# EAGLE board Resistor_Resistor (EAGLE 8.3.0), part 29 of 32
## Placement (x,y rotation side) (continued)
R35434  10K  [0201]  241.15,21.39 0 top
R35435  10K  [0201]  241.15,22 0 top
R35436  10K  [0201]  241.15,22.61 0 top
R35437  10K  [0201]  241.15,23.22 0 top
R35438  10K  [0201]  241.15,23.83 0 top
R35439  10K  [0201]  241.15,24.43 0 top
R35440  10K  [0201]  241.15,25.04 0 top
R35441  10K  [0201]  241.15,25.65 0 top
R35442  10K  [0201]  241.15,26.26 0 top
R35443  10K  [0201]  241.15,26.87 0 top
R35444  10K  [0201]  241.15,27.48 0 top
R35445  10K  [0201]  241.15,28.09 0 top
R35446  10K  [0201]  241.15,28.7 0 top
R35447  10K  [0201]  241.15,29.31 0 top
R35448  10K  [0201]  241.15,29.92 0 top
R35449  10K  [0201]  241.15,30.53 0 top
R35450  10K  [0201]  241.15,31.14 0 top
R35451  10K  [0201]  241.15,31.75 0 top
R35452  10K  [0201]  241.15,32.36 0 top
R35453  10K  [0201]  241.15,32.97 0 top
R35454  10K  [0201]  241.15,33.58 0 top
R35455  10K  [0201]  241.15,34.19 0 top
R35456  10K  [0201]  241.15,34.8 0 top
R35457  10K  [0201]  241.15,35.41 0 top
R35458  10K  [0201]  241.15,36.02 0 top
R35459  10K  [0201]  241.15,36.63 0 top
R35460  10K  [0201]  241.15,37.24 0 top
R35461  10K  [0201]  241.15,37.85 0 top
R35462  10K  [0201]  241.15,38.46 0 top
R35463  10K  [0201]  241.15,39.07 0 top
R35464  10K  [0201]  241.15,39.67 0 top
R35465  10K  [0201]  241.15,40.28 0 top
R35466  10K  [0201]  241.15,40.89 0 top
R35467  10K  [0201]  241.15,41.5 0 top
R35468  10K  [0201]  241.15,42.11 0 top
R35469  10K  [0201]  241.15,42.72 0 top
R35470  10K  [0201]  241.15,43.33 0 top
R35471  10K  [0201]  241.15,43.94 0 top
R35472  10K  [0201]  241.15,44.55 0 top
R35473  10K  [0201]  241.15,45.16 0 top
R35474  10K  [0201]  241.15,45.77 0 top
R35475  10K  [0201]  241.15,46.38 0 top
R35476  10K  [0201]  241.15,46.99 0 top
R35477  10K  [0201]  241.15,47.6 0 top
R35478  10K  [0201]  241.15,48.21 0 top
R35479  10K  [0201]  241.15,48.82 0 top
R35480  10K  [0201]  241.15,49.43 0 top
R35481  10K  [0201]  241.15,50.04 0 top
R35482  10K  [0201]  241.15,50.65 0 top
R35483  10K  [0201]  241.15,51.26 0 top
R35484  10K  [0201]  241.15,51.87 0 top
R35485  10K  [0201]  241.15,52.48 0 top
R35486  10K  [0201]  241.15,53.09 0 top
R35487  10K  [0201]  241.15,53.7 0 top
R35488  10K  [0201]  241.15,54.31 0 top
R35489  10K  [0201]  241.15,54.91 0 top
R35490  10K  [0201]  241.15,55.52 0 top
R35491  10K  [0201]  241.15,56.13 0 top
R35492  10K  [0201]  241.15,56.74 0 top
R35493  10K  [0201]  241.15,57.35 0 top
R35494  10K  [0201]  241.15,57.96 0 top
R35495  10K  [0201]  241.15,58.57 0 top
R35496  10K  [0201]  241.15,59.18 0 top
R35497  10K  [0201]  241.15,59.79 0 top
R35498  10K  [0201]  241.15,60.4 0 top
R35499  10K  [0201]  241.15,61.01 0 top
R35500  10K  [0201]  241.15,61.62 0 top
R35501  10K  [0201]  241.15,62.23 0 top
R35502  10K  [0201]  241.15,62.84 0 top
R35503  10K  [0201]  241.15,63.45 0 top
R35504  10K  [0201]  241.15,64.06 0 top
R35505  10K  [0201]  241.15,64.67 0 top
R35506  10K  [0201]  241.15,65.28 0 top
R35507  10K  [0201]  241.15,65.89 0 top
R35508  10K  [0201]  241.15,66.5 0 top
R35509  10K  [0201]  241.15,67.11 0 top
R35510  10K  [0201]  241.15,67.72 0 top
R35511  10K  [0201]  241.15,68.33 0 top
R35512  10K  [0201]  241.15,68.94 0 top
R35513  10K  [0201]  241.15,69.55 0 top
R35514  10K  [0201]  241.15,70.15 0 top
R35515  10K  [0201]  241.15,70.76 0 top
R35516  10K  [0201]  241.15,71.37 0 top
R35517  10K  [0201]  241.15,71.98 0 top
R35518  10K  [0201]  241.15,72.59 0 top
R35519  10K  [0201]  241.15,73.2 0 top
R35520  10K  [0201]  241.15,73.81 0 top
R35521  10K  [0201]  241.15,74.42 0 top
R35522  10K  [0201]  241.15,75.03 0 top
R35523  10K  [0201]  241.15,75.64 0 top
R35524  10K  [0201]  241.15,76.25 0 top
R35525  10K  [0201]  241.15,76.86 0 top
R35526  10K  [0201]  241.15,77.47 0 top
R35527  10K  [0201]  241.15,78.08 0 top
R35528  10K  [0201]  241.15,78.69 0 top
R35529  10K  [0201]  241.15,79.3 0 top
R35530  10K  [0201]  241.15,79.91 0 top
R35531  10K  [0201]  241.15,80.52 0 top
R35532  10K  [0201]  241.15,81.13 0 top
R35533  10K  [0201]  241.15,81.74 0 top
R35534  10K  [0201]  241.15,82.35 0 top
R35535  10K  [0201]  241.15,82.96 0 top
R35536  10K  [0201]  241.15,83.57 0 top
R35537  10K  [0201]  241.15,84.18 0 top
R35538  10K  [0201]  241.15,84.79 0 top
R35539  10K  [0201]  241.15,85.39 0 top
R35540  10K  [0201]  241.15,86 0 top
R35541  10K  [0201]  241.15,86.61 0 top
R35542  10K  [0201]  241.15,87.22 0 top
R35543  10K  [0201]  241.15,87.83 0 top
R35544  10K  [0201]  241.15,88.44 0 top
R35545  10K  [0201]  241.15,89.05 0 top
R35546  10K  [0201]  241.15,89.66 0 top
R35547  10K  [0201]  241.15,90.27 0 top
R35548  10K  [0201]  241.15,90.88 0 top
R35549  10K  [0201]  241.15,91.49 0 top
R35550  10K  [0201]  241.15,92.1 0 top
R35551  10K  [0201]  241.15,92.71 0 top
R35552  10K  [0201]  241.15,93.32 0 top
R35553  10K  [0201]  241.15,93.93 0 top
R35554  10K  [0201]  241.15,94.54 0 top
R35555  10K  [0201]  241.15,95.15 0 top
R35556  10K  [0201]  241.15,95.76 0 top
R35557  10K  [0201]  241.15,96.37 0 top
R35558  10K  [0201]  241.15,96.98 0 top
R35559  10K  [0201]  241.15,97.59 0 top
R35560  10K  [0201]  241.15,98.2 0 top
R35561  10K  [0201]  241.15,98.81 0 top
R35562  10K  [0201]  241.15,99.42 0 top
R35563  10K  [0201]  241.15,100.03 0 top
R35564  10K  [0201]  241.15,100.63 0 top
R35565  10K  [0201]  241.15,101.24 0 top
R35566  10K  [0201]  241.15,101.85 0 top
R35567  10K  [0201]  241.15,102.46 0 top
R35568  10K  [0201]  241.15,103.07 0 top
R35569  10K  [0201]  241.15,103.68 0 top
R35570  10K  [0201]  241.15,104.29 0 top
R35571  10K  [0201]  241.15,104.9 0 top
R35572  10K  [0201]  241.15,105.51 0 top
R35573  10K  [0201]  241.15,106.12 0 top
R35574  10K  [0201]  241.15,106.73 0 top
R35575  10K  [0201]  241.15,107.34 0 top
R35576  10K  [0201]  241.15,107.95 0 top
R35577  10K  [0201]  241.15,108.56 0 top
R35578  10K  [0201]  241.15,109.17 0 top
R35579  10K  [0201]  241.15,109.78 0 top
R35580  10K  [0201]  241.15,110.39 0 top
R35581  10K  [0201]  241.15,111 0 top
R35582  10K  [0201]  241.15,111.61 0 top
R35583  10K  [0201]  241.15,112.22 0 top
R35584  10K  [0201]  241.15,112.83 0 top
R35585  10K  [0201]  241.15,113.44 0 top
R35586  10K  [0201]  241.15,114.05 0 top
R35587  10K  [0201]  241.15,114.66 0 top
R35588  10K  [0201]  241.15,115.27 0 top
R35589  10K  [0201]  241.15,115.87 0 top
R35590  10K  [0201]  241.15,116.48 0 top
R35591  10K  [0201]  241.15,117.09 0 top
R35592  10K  [0201]  241.15,117.7 0 top
R35593  10K  [0201]  241.15,118.31 0 top
R35594  10K  [0201]  241.15,118.92 0 top
R35595  10K  [0201]  241.15,119.53 0 top
R35596  10K  [0201]  241.15,120.14 0 top
R35597  10K  [0201]  241.15,120.75 0 top
R35598  10K  [0201]  241.15,121.36 0 top
R35599  10K  [0201]  241.15,121.97 0 top
R35600  10K  [0201]  241.15,122.58 0 top
R35601  10K  [0201]  242.37,1.27 0 top
R35602  10K  [0201]  242.37,1.88 0 top
R35603  10K  [0201]  242.37,2.49 0 top
R35604  10K  [0201]  242.37,3.1 0 top
R35605  10K  [0201]  242.37,3.71 0 top
R35606  10K  [0201]  242.37,4.32 0 top
R35607  10K  [0201]  242.37,4.93 0 top
R35608  10K  [0201]  242.37,5.54 0 top
R35609  10K  [0201]  242.37,6.15 0 top
R35610  10K  [0201]  242.37,6.76 0 top
R35611  10K  [0201]  242.37,7.37 0 top
R35612  10K  [0201]  242.37,7.98 0 top
R35613  10K  [0201]  242.37,8.59 0 top
R35614  10K  [0201]  242.37,9.19 0 top
R35615  10K  [0201]  242.37,9.8 0 top
R35616  10K  [0201]  242.37,10.41 0 top
R35617  10K  [0201]  242.37,11.02 0 top
R35618  10K  [0201]  242.37,11.63 0 top
R35619  10K  [0201]  242.37,12.24 0 top
R35620  10K  [0201]  242.37,12.85 0 top
R35621  10K  [0201]  242.37,13.46 0 top
R35622  10K  [0201]  242.37,14.07 0 top
R35623  10K  [0201]  242.37,14.68 0 top
R35624  10K  [0201]  242.37,15.29 0 top
R35625  10K  [0201]  242.37,15.9 0 top
R35626  10K  [0201]  242.37,16.51 0 top
R35627  10K  [0201]  242.37,17.12 0 top
R35628  10K  [0201]  242.37,17.73 0 top
R35629  10K  [0201]  242.37,18.34 0 top
R35630  10K  [0201]  242.37,18.95 0 top
R35631  10K  [0201]  242.37,19.56 0 top
R35632  10K  [0201]  242.37,20.17 0 top
R35633  10K  [0201]  242.37,20.78 0 top
R35634  10K  [0201]  242.37,21.39 0 top
R35635  10K  [0201]  242.37,22 0 top
R35636  10K  [0201]  242.37,22.61 0 top
R35637  10K  [0201]  242.37,23.22 0 top
R35638  10K  [0201]  242.37,23.83 0 top
R35639  10K  [0201]  242.37,24.43 0 top
R35640  10K  [0201]  242.37,25.04 0 top
R35641  10K  [0201]  242.37,25.65 0 top
R35642  10K  [0201]  242.37,26.26 0 top
R35643  10K  [0201]  242.37,26.87 0 top
R35644  10K  [0201]  242.37,27.48 0 top
R35645  10K  [0201]  242.37,28.09 0 top
R35646  10K  [0201]  242.37,28.7 0 top
R35647  10K  [0201]  242.37,29.31 0 top
R35648  10K  [0201]  242.37,29.92 0 top
R35649  10K  [0201]  242.37,30.53 0 top
R35650  10K  [0201]  242.37,31.14 0 top
R35651  10K  [0201]  242.37,31.75 0 top
R35652  10K  [0201]  242.37,32.36 0 top
R35653  10K  [0201]  242.37,32.97 0 top
R35654  10K  [0201]  242.37,33.58 0 top
R35655  10K  [0201]  242.37,34.19 0 top
R35656  10K  [0201]  242.37,34.8 0 top
R35657  10K  [0201]  242.37,35.41 0 top
R35658  10K  [0201]  242.37,36.02 0 top
R35659  10K  [0201]  242.37,36.63 0 top
R35660  10K  [0201]  242.37,37.24 0 top
R35661  10K  [0201]  242.37,37.85 0 top
R35662  10K  [0201]  242.37,38.46 0 top
R35663  10K  [0201]  242.37,39.07 0 top
R35664  10K  [0201]  242.37,39.67 0 top
R35665  10K  [0201]  242.37,40.28 0 top
R35666  10K  [0201]  242.37,40.89 0 top
R35667  10K  [0201]  242.37,41.5 0 top
R35668  10K  [0201]  242.37,42.11 0 top
R35669  10K  [0201]  242.37,42.72 0 top
R35670  10K  [0201]  242.37,43.33 0 top
R35671  10K  [0201]  242.37,43.94 0 top
R35672  10K  [0201]  242.37,44.55 0 top
R35673  10K  [0201]  242.37,45.16 0 top
R35674  10K  [0201]  242.37,45.77 0 top
R35675  10K  [0201]  242.37,46.38 0 top
R35676  10K  [0201]  242.37,46.99 0 top
R35677  10K  [0201]  242.37,47.6 0 top
R35678  10K  [0201]  242.37,48.21 0 top
R35679  10K  [0201]  242.37,48.82 0 top
R35680  10K  [0201]  242.37,49.43 0 top
R35681  10K  [0201]  242.37,50.04 0 top
R35682  10K  [0201]  242.37,50.65 0 top
R35683  10K  [0201]  242.37,51.26 0 top
R35684  10K  [0201]  242.37,51.87 0 top
R35685  10K  [0201]  242.37,52.48 0 top
R35686  10K  [0201]  242.37,53.09 0 top
R35687  10K  [0201]  242.37,53.7 0 top
R35688  10K  [0201]  242.37,54.31 0 top
R35689  10K  [0201]  242.37,54.91 0 top
R35690  10K  [0201]  242.37,55.52 0 top
R35691  10K  [0201]  242.37,56.13 0 top
R35692  10K  [0201]  242.37,56.74 0 top
R35693  10K  [0201]  242.37,57.35 0 top
R35694  10K  [0201]  242.37,57.96 0 top
R35695  10K  [0201]  242.37,58.57 0 top
R35696  10K  [0201]  242.37,59.18 0 top
R35697  10K  [0201]  242.37,59.79 0 top
R35698  10K  [0201]  242.37,60.4 0 top
R35699  10K  [0201]  242.37,61.01 0 top
R35700  10K  [0201]  242.37,61.62 0 top
R35701  10K  [0201]  242.37,62.23 0 top
R35702  10K  [0201]  242.37,62.84 0 top
R35703  10K  [0201]  242.37,63.45 0 top
R35704  10K  [0201]  242.37,64.06 0 top
R35705  10K  [0201]  242.37,64.67 0 top
R35706  10K  [0201]  242.37,65.28 0 top
R35707  10K  [0201]  242.37,65.89 0 top
R35708  10K  [0201]  242.37,66.5 0 top
R35709  10K  [0201]  242.37,67.11 0 top
R35710  10K  [0201]  242.37,67.72 0 top
R35711  10K  [0201]  242.37,68.33 0 top
R35712  10K  [0201]  242.37,68.94 0 top
R35713  10K  [0201]  242.37,69.55 0 top
R35714  10K  [0201]  242.37,70.15 0 top
R35715  10K  [0201]  242.37,70.76 0 top
R35716  10K  [0201]  242.37,71.37 0 top
R35717  10K  [0201]  242.37,71.98 0 top
R35718  10K  [0201]  242.37,72.59 0 top
R35719  10K  [0201]  242.37,73.2 0 top
R35720  10K  [0201]  242.37,73.81 0 top
R35721  10K  [0201]  242.37,74.42 0 top
R35722  10K  [0201]  242.37,75.03 0 top
R35723  10K  [0201]  242.37,75.64 0 top
R35724  10K  [0201]  242.37,76.25 0 top
R35725  10K  [0201]  242.37,76.86 0 top
R35726  10K  [0201]  242.37,77.47 0 top
R35727  10K  [0201]  242.37,78.08 0 top
R35728  10K  [0201]  242.37,78.69 0 top
R35729  10K  [0201]  242.37,79.3 0 top
R35730  10K  [0201]  242.37,79.91 0 top
R35731  10K  [0201]  242.37,80.52 0 top
R35732  10K  [0201]  242.37,81.13 0 top
R35733  10K  [0201]  242.37,81.74 0 top
R35734  10K  [0201]  242.37,82.35 0 top
R35735  10K  [0201]  242.37,82.96 0 top
R35736  10K  [0201]  242.37,83.57 0 top
R35737  10K  [0201]  242.37,84.18 0 top
R35738  10K  [0201]  242.37,84.79 0 top
R35739  10K  [0201]  242.37,85.39 0 top
R35740  10K  [0201]  242.37,86 0 top
R35741  10K  [0201]  242.37,86.61 0 top
R35742  10K  [0201]  242.37,87.22 0 top
R35743  10K  [0201]  242.37,87.83 0 top
R35744  10K  [0201]  242.37,88.44 0 top
R35745  10K  [0201]  242.37,89.05 0 top
R35746  10K  [0201]  242.37,89.66 0 top
R35747  10K  [0201]  242.37,90.27 0 top
R35748  10K  [0201]  242.37,90.88 0 top
R35749  10K  [0201]  242.37,91.49 0 top
R35750  10K  [0201]  242.37,92.1 0 top
R35751  10K  [0201]  242.37,92.71 0 top
R35752  10K  [0201]  242.37,93.32 0 top
R35753  10K  [0201]  242.37,93.93 0 top
R35754  10K  [0201]  242.37,94.54 0 top
R35755  10K  [0201]  242.37,95.15 0 top
R35756  10K  [0201]  242.37,95.76 0 top
R35757  10K  [0201]  242.37,96.37 0 top
R35758  10K  [0201]  242.37,96.98 0 top
R35759  10K  [0201]  242.37,97.59 0 top
R35760  10K  [0201]  242.37,98.2 0 top
R35761  10K  [0201]  242.37,98.81 0 top
R35762  10K  [0201]  242.37,99.42 0 top
R35763  10K  [0201]  242.37,100.03 0 top
R35764  10K  [0201]  242.37,100.63 0 top
R35765  10K  [0201]  242.37,101.24 0 top
R35766  10K  [0201]  242.37,101.85 0 top
R35767  10K  [0201]  242.37,102.46 0 top
R35768  10K  [0201]  242.37,103.07 0 top
R35769  10K  [0201]  242.37,103.68 0 top
R35770  10K  [0201]  242.37,104.29 0 top
R35771  10K  [0201]  242.37,104.9 0 top
R35772  10K  [0201]  242.37,105.51 0 top
R35773  10K  [0201]  242.37,106.12 0 top
R35774  10K  [0201]  242.37,106.73 0 top
R35775  10K  [0201]  242.37,107.34 0 top
R35776  10K  [0201]  242.37,107.95 0 top
R35777  10K  [0201]  242.37,108.56 0 top
R35778  10K  [0201]  242.37,109.17 0 top
R35779  10K  [0201]  242.37,109.78 0 top
R35780  10K  [0201]  242.37,110.39 0 top
R35781  10K  [0201]  242.37,111 0 top
R35782  10K  [0201]  242.37,111.61 0 top
R35783  10K  [0201]  242.37,112.22 0 top
R35784  10K  [0201]  242.37,112.83 0 top
R35785  10K  [0201]  242.37,113.44 0 top
R35786  10K  [0201]  242.37,114.05 0 top
R35787  10K  [0201]  242.37,114.66 0 top
R35788  10K  [0201]  242.37,115.27 0 top
R35789  10K  [0201]  242.37,115.87 0 top
R35790  10K  [0201]  242.37,116.48 0 top
R35791  10K  [0201]  242.37,117.09 0 top
R35792  10K  [0201]  242.37,117.7 0 top
R35793  10K  [0201]  242.37,118.31 0 top
R35794  10K  [0201]  242.37,118.92 0 top
R35795  10K  [0201]  242.37,119.53 0 top
R35796  10K  [0201]  242.37,120.14 0 top
R35797  10K  [0201]  242.37,120.75 0 top
R35798  10K  [0201]  242.37,121.36 0 top
R35799  10K  [0201]  242.37,121.97 0 top
R35800  10K  [0201]  242.37,122.58 0 top
R35801  10K  [0201]  243.59,1.27 0 top
R35802  10K  [0201]  243.59,1.88 0 top
R35803  10K  [0201]  243.59,2.49 0 top
R35804  10K  [0201]  243.59,3.1 0 top
R35805  10K  [0201]  243.59,3.71 0 top
R35806  10K  [0201]  243.59,4.32 0 top
R35807  10K  [0201]  243.59,4.93 0 top
R35808  10K  [0201]  243.59,5.54 0 top
R35809  10K  [0201]  243.59,6.15 0 top
R35810  10K  [0201]  243.59,6.76 0 top
R35811  10K  [0201]  243.59,7.37 0 top
R35812  10K  [0201]  243.59,7.98 0 top
R35813  10K  [0201]  243.59,8.59 0 top
R35814  10K  [0201]  243.59,9.19 0 top
R35815  10K  [0201]  243.59,9.8 0 top
R35816  10K  [0201]  243.59,10.41 0 top
R35817  10K  [0201]  243.59,11.02 0 top
R35818  10K  [0201]  243.59,11.63 0 top
R35819  10K  [0201]  243.59,12.24 0 top
R35820  10K  [0201]  243.59,12.85 0 top
R35821  10K  [0201]  243.59,13.46 0 top
R35822  10K  [0201]  243.59,14.07 0 top
R35823  10K  [0201]  243.59,14.68 0 top
R35824  10K  [0201]  243.59,15.29 0 top
R35825  10K  [0201]  243.59,15.9 0 top
R35826  10K  [0201]  243.59,16.51 0 top
R35827  10K  [0201]  243.59,17.12 0 top
R35828  10K  [0201]  243.59,17.73 0 top
R35829  10K  [0201]  243.59,18.34 0 top
R35830  10K  [0201]  243.59,18.95 0 top
R35831  10K  [0201]  243.59,19.56 0 top
R35832  10K  [0201]  243.59,20.17 0 top
R35833  10K  [0201]  243.59,20.78 0 top
R35834  10K  [0201]  243.59,21.39 0 top
R35835  10K  [0201]  243.59,22 0 top
R35836  10K  [0201]  243.59,22.61 0 top
R35837  10K  [0201]  243.59,23.22 0 top
R35838  10K  [0201]  243.59,23.83 0 top
R35839  10K  [0201]  243.59,24.43 0 top
R35840  10K  [0201]  243.59,25.04 0 top
R35841  10K  [0201]  243.59,25.65 0 top
R35842  10K  [0201]  243.59,26.26 0 top
R35843  10K  [0201]  243.59,26.87 0 top
R35844  10K  [0201]  243.59,27.48 0 top
R35845  10K  [0201]  243.59,28.09 0 top
R35846  10K  [0201]  243.59,28.7 0 top
R35847  10K  [0201]  243.59,29.31 0 top
R35848  10K  [0201]  243.59,29.92 0 top
R35849  10K  [0201]  243.59,30.53 0 top
R35850  10K  [0201]  243.59,31.14 0 top
R35851  10K  [0201]  243.59,31.75 0 top
R35852  10K  [0201]  243.59,32.36 0 top
R35853  10K  [0201]  243.59,32.97 0 top
R35854  10K  [0201]  243.59,33.58 0 top
R35855  10K  [0201]  243.59,34.19 0 top
R35856  10K  [0201]  243.59,34.8 0 top
R35857  10K  [0201]  243.59,35.41 0 top
R35858  10K  [0201]  243.59,36.02 0 top
R35859  10K  [0201]  243.59,36.63 0 top
R35860  10K  [0201]  243.59,37.24 0 top
R35861  10K  [0201]  243.59,37.85 0 top
R35862  10K  [0201]  243.59,38.46 0 top
R35863  10K  [0201]  243.59,39.07 0 top
R35864  10K  [0201]  243.59,39.67 0 top
R35865  10K  [0201]  243.59,40.28 0 top
R35866  10K  [0201]  243.59,40.89 0 top
R35867  10K  [0201]  243.59,41.5 0 top
R35868  10K  [0201]  243.59,42.11 0 top
R35869  10K  [0201]  243.59,42.72 0 top
R35870  10K  [0201]  243.59,43.33 0 top
R35871  10K  [0201]  243.59,43.94 0 top
R35872  10K  [0201]  243.59,44.55 0 top
R35873  10K  [0201]  243.59,45.16 0 top
R35874  10K  [0201]  243.59,45.77 0 top
R35875  10K  [0201]  243.59,46.38 0 top
R35876  10K  [0201]  243.59,46.99 0 top
R35877  10K  [0201]  243.59,47.6 0 top
R35878  10K  [0201]  243.59,48.21 0 top
R35879  10K  [0201]  243.59,48.82 0 top
R35880  10K  [0201]  243.59,49.43 0 top
R35881  10K  [0201]  243.59,50.04 0 top
R35882  10K  [0201]  243.59,50.65 0 top
R35883  10K  [0201]  243.59,51.26 0 top
R35884  10K  [0201]  243.59,51.87 0 top
R35885  10K  [0201]  243.59,52.48 0 top
R35886  10K  [0201]  243.59,53.09 0 top
R35887  10K  [0201]  243.59,53.7 0 top
R35888  10K  [0201]  243.59,54.31 0 top
R35889  10K  [0201]  243.59,54.91 0 top
R35890  10K  [0201]  243.59,55.52 0 top
R35891  10K  [0201]  243.59,56.13 0 top
R35892  10K  [0201]  243.59,56.74 0 top
R35893  10K  [0201]  243.59,57.35 0 top
R35894  10K  [0201]  243.59,57.96 0 top
R35895  10K  [0201]  243.59,58.57 0 top
R35896  10K  [0201]  243.59,59.18 0 top
R35897  10K  [0201]  243.59,59.79 0 top
R35898  10K  [0201]  243.59,60.4 0 top
R35899  10K  [0201]  243.59,61.01 0 top
R35900  10K  [0201]  243.59,61.62 0 top
R35901  10K  [0201]  243.59,62.23 0 top
R35902  10K  [0201]  243.59,62.84 0 top
R35903  10K  [0201]  243.59,63.45 0 top
R35904  10K  [0201]  243.59,64.06 0 top
R35905  10K  [0201]  243.59,64.67 0 top
R35906  10K  [0201]  243.59,65.28 0 top
R35907  10K  [0201]  243.59,65.89 0 top
R35908  10K  [0201]  243.59,66.5 0 top
R35909  10K  [0201]  243.59,67.11 0 top
R35910  10K  [0201]  243.59,67.72 0 top
R35911  10K  [0201]  243.59,68.33 0 top
R35912  10K  [0201]  243.59,68.94 0 top
R35913  10K  [0201]  243.59,69.55 0 top
R35914  10K  [0201]  243.59,70.15 0 top
R35915  10K  [0201]  243.59,70.76 0 top
R35916  10K  [0201]  243.59,71.37 0 top
R35917  10K  [0201]  243.59,71.98 0 top
R35918  10K  [0201]  243.59,72.59 0 top
R35919  10K  [0201]  243.59,73.2 0 top
R35920  10K  [0201]  243.59,73.81 0 top
R35921  10K  [0201]  243.59,74.42 0 top
R35922  10K  [0201]  243.59,75.03 0 top
R35923  10K  [0201]  243.59,75.64 0 top
R35924  10K  [0201]  243.59,76.25 0 top
R35925  10K  [0201]  243.59,76.86 0 top
R35926  10K  [0201]  243.59,77.47 0 top
R35927  10K  [0201]  243.59,78.08 0 top
R35928  10K  [0201]  243.59,78.69 0 top
R35929  10K  [0201]  243.59,79.3 0 top
R35930  10K  [0201]  243.59,79.91 0 top
R35931  10K  [0201]  243.59,80.52 0 top
R35932  10K  [0201]  243.59,81.13 0 top
R35933  10K  [0201]  243.59,81.74 0 top
R35934  10K  [0201]  243.59,82.35 0 top
R35935  10K  [0201]  243.59,82.96 0 top
R35936  10K  [0201]  243.59,83.57 0 top
R35937  10K  [0201]  243.59,84.18 0 top
R35938  10K  [0201]  243.59,84.79 0 top
R35939  10K  [0201]  243.59,85.39 0 top
R35940  10K  [0201]  243.59,86 0 top
R35941  10K  [0201]  243.59,86.61 0 top
R35942  10K  [0201]  243.59,87.22 0 top
R35943  10K  [0201]  243.59,87.83 0 top
R35944  10K  [0201]  243.59,88.44 0 top
R35945  10K  [0201]  243.59,89.05 0 top
R35946  10K  [0201]  243.59,89.66 0 top
R35947  10K  [0201]  243.59,90.27 0 top
R35948  10K  [0201]  243.59,90.88 0 top
R35949  10K  [0201]  243.59,91.49 0 top
R35950  10K  [0201]  243.59,92.1 0 top
R35951  10K  [0201]  243.59,92.71 0 top
R35952  10K  [0201]  243.59,93.32 0 top
R35953  10K  [0201]  243.59,93.93 0 top
R35954  10K  [0201]  243.59,94.54 0 top
R35955  10K  [0201]  243.59,95.15 0 top
R35956  10K  [0201]  243.59,95.76 0 top
R35957  10K  [0201]  243.59,96.37 0 top
R35958  10K  [0201]  243.59,96.98 0 top
R35959  10K  [0201]  243.59,97.59 0 top
R35960  10K  [0201]  243.59,98.2 0 top
R35961  10K  [0201]  243.59,98.81 0 top
R35962  10K  [0201]  243.59,99.42 0 top
R35963  10K  [0201]  243.59,100.03 0 top
R35964  10K  [0201]  243.59,100.63 0 top
R35965  10K  [0201]  243.59,101.24 0 top
R35966  10K  [0201]  243.59,101.85 0 top
R35967  10K  [0201]  243.59,102.46 0 top
R35968  10K  [0201]  243.59,103.07 0 top
R35969  10K  [0201]  243.59,103.68 0 top
R35970  10K  [0201]  243.59,104.29 0 top
R35971  10K  [0201]  243.59,104.9 0 top
R35972  10K  [0201]  243.59,105.51 0 top
R35973  10K  [0201]  243.59,106.12 0 top
R35974  10K  [0201]  243.59,106.73 0 top
R35975  10K  [0201]  243.59,107.34 0 top
R35976  10K  [0201]  243.59,107.95 0 top
R35977  10K  [0201]  243.59,108.56 0 top
R35978  10K  [0201]  243.59,109.17 0 top
R35979  10K  [0201]  243.59,109.78 0 top
R35980  10K  [0201]  243.59,110.39 0 top
R35981  10K  [0201]  243.59,111 0 top
R35982  10K  [0201]  243.59,111.61 0 top
R35983  10K  [0201]  243.59,112.22 0 top
R35984  10K  [0201]  243.59,112.83 0 top
R35985  10K  [0201]  243.59,113.44 0 top
R35986  10K  [0201]  243.59,114.05 0 top
R35987  10K  [0201]  243.59,114.66 0 top
R35988  10K  [0201]  243.59,115.27 0 top
R35989  10K  [0201]  243.59,115.87 0 top
R35990  10K  [0201]  243.59,116.48 0 top
R35991  10K  [0201]  243.59,117.09 0 top
R35992  10K  [0201]  243.59,117.7 0 top
R35993  10K  [0201]  243.59,118.31 0 top
R35994  10K  [0201]  243.59,118.92 0 top
R35995  10K  [0201]  243.59,119.53 0 top
R35996  10K  [0201]  243.59,120.14 0 top
R35997  10K  [0201]  243.59,120.75 0 top
R35998  10K  [0201]  243.59,121.36 0 top
R35999  10K  [0201]  243.59,121.97 0 top
R36000  10K  [0201]  243.59,122.58 0 top
R36001  10K  [0201]  244.81,1.27 0 top
R36002  10K  [0201]  244.81,1.88 0 top
R36003  10K  [0201]  244.81,2.49 0 top
R36004  10K  [0201]  244.81,3.1 0 top
R36005  10K  [0201]  244.81,3.71 0 top
R36006  10K  [0201]  244.81,4.32 0 top
R36007  10K  [0201]  244.81,4.93 0 top
R36008  10K  [0201]  244.81,5.54 0 top
R36009  10K  [0201]  244.81,6.15 0 top
R36010  10K  [0201]  244.81,6.76 0 top
R36011  10K  [0201]  244.81,7.37 0 top
R36012  10K  [0201]  244.81,7.98 0 top
R36013  10K  [0201]  244.81,8.59 0 top
R36014  10K  [0201]  244.81,9.19 0 top
R36015  10K  [0201]  244.81,9.8 0 top
R36016  10K  [0201]  244.81,10.41 0 top
R36017  10K  [0201]  244.81,11.02 0 top
R36018  10K  [0201]  244.81,11.63 0 top
R36019  10K  [0201]  244.81,12.24 0 top
R36020  10K  [0201]  244.81,12.85 0 top
R36021  10K  [0201]  244.81,13.46 0 top
R36022  10K  [0201]  244.81,14.07 0 top
R36023  10K  [0201]  244.81,14.68 0 top
R36024  10K  [0201]  244.81,15.29 0 top
R36025  10K  [0201]  244.81,15.9 0 top
R36026  10K  [0201]  244.81,16.51 0 top
R36027  10K  [0201]  244.81,17.12 0 top
R36028  10K  [0201]  244.81,17.73 0 top
R36029  10K  [0201]  244.81,18.34 0 top
R36030  10K  [0201]  244.81,18.95 0 top
R36031  10K  [0201]  244.81,19.56 0 top
R36032  10K  [0201]  244.81,20.17 0 top
R36033  10K  [0201]  244.81,20.78 0 top
R36034  10K  [0201]  244.81,21.39 0 top
R36035  10K  [0201]  244.81,22 0 top
R36036  10K  [0201]  244.81,22.61 0 top
R36037  10K  [0201]  244.81,23.22 0 top
R36038  10K  [0201]  244.81,23.83 0 top
R36039  10K  [0201]  244.81,24.43 0 top
R36040  10K  [0201]  244.81,25.04 0 top
R36041  10K  [0201]  244.81,25.65 0 top
R36042  10K  [0201]  244.81,26.26 0 top
R36043  10K  [0201]  244.81,26.87 0 top
R36044  10K  [0201]  244.81,27.48 0 top
R36045  10K  [0201]  244.81,28.09 0 top
R36046  10K  [0201]  244.81,28.7 0 top
R36047  10K  [0201]  244.81,29.31 0 top
R36048  10K  [0201]  244.81,29.92 0 top
R36049  10K  [0201]  244.81,30.53 0 top
R36050  10K  [0201]  244.81,31.14 0 top
R36051  10K  [0201]  244.81,31.75 0 top
R36052  10K  [0201]  244.81,32.36 0 top
R36053  10K  [0201]  244.81,32.97 0 top
R36054  10K  [0201]  244.81,33.58 0 top
R36055  10K  [0201]  244.81,34.19 0 top
R36056  10K  [0201]  244.81,34.8 0 top
R36057  10K  [0201]  244.81,35.41 0 top
R36058  10K  [0201]  244.81,36.02 0 top
R36059  10K  [0201]  244.81,36.63 0 top
R36060  10K  [0201]  244.81,37.24 0 top
R36061  10K  [0201]  244.81,37.85 0 top
R36062  10K  [0201]  244.81,38.46 0 top
R36063  10K  [0201]  244.81,39.07 0 top
R36064  10K  [0201]  244.81,39.67 0 top
R36065  10K  [0201]  244.81,40.28 0 top
R36066  10K  [0201]  244.81,40.89 0 top
R36067  10K  [0201]  244.81,41.5 0 top
R36068  10K  [0201]  244.81,42.11 0 top
R36069  10K  [0201]  244.81,42.72 0 top
R36070  10K  [0201]  244.81,43.33 0 top
R36071  10K  [0201]  244.81,43.94 0 top
R36072  10K  [0201]  244.81,44.55 0 top
R36073  10K  [0201]  244.81,45.16 0 top
R36074  10K  [0201]  244.81,45.77 0 top
R36075  10K  [0201]  244.81,46.38 0 top
R36076  10K  [0201]  244.81,46.99 0 top
R36077  10K  [0201]  244.81,47.6 0 top
R36078  10K  [0201]  244.81,48.21 0 top
R36079  10K  [0201]  244.81,48.82 0 top
R36080  10K  [0201]  244.81,49.43 0 top
R36081  10K  [0201]  244.81,50.04 0 top
R36082  10K  [0201]  244.81,50.65 0 top
R36083  10K  [0201]  244.81,51.26 0 top
R36084  10K  [0201]  244.81,51.87 0 top
R36085  10K  [0201]  244.81,52.48 0 top
R36086  10K  [0201]  244.81,53.09 0 top
R36087  10K  [0201]  244.81,53.7 0 top
R36088  10K  [0201]  244.81,54.31 0 top
R36089  10K  [0201]  244.81,54.91 0 top
R36090  10K  [0201]  244.81,55.52 0 top
R36091  10K  [0201]  244.81,56.13 0 top
R36092  10K  [0201]  244.81,56.74 0 top
R36093  10K  [0201]  244.81,57.35 0 top
R36094  10K  [0201]  244.81,57.96 0 top
R36095  10K  [0201]  244.81,58.57 0 top
R36096  10K  [0201]  244.81,59.18 0 top
R36097  10K  [0201]  244.81,59.79 0 top
R36098  10K  [0201]  244.81,60.4 0 top
R36099  10K  [0201]  244.81,61.01 0 top
R36100  10K  [0201]  244.81,61.62 0 top
R36101  10K  [0201]  244.81,62.23 0 top
R36102  10K  [0201]  244.81,62.84 0 top
R36103  10K  [0201]  244.81,63.45 0 top
R36104  10K  [0201]  244.81,64.06 0 top
R36105  10K  [0201]  244.81,64.67 0 top
R36106  10K  [0201]  244.81,65.28 0 top
R36107  10K  [0201]  244.81,65.89 0 top
R36108  10K  [0201]  244.81,66.5 0 top
R36109  10K  [0201]  244.81,67.11 0 top
R36110  10K  [0201]  244.81,67.72 0 top
R36111  10K  [0201]  244.81,68.33 0 top
R36112  10K  [0201]  244.81,68.94 0 top
R36113  10K  [0201]  244.81,69.55 0 top
R36114  10K  [0201]  244.81,70.15 0 top
R36115  10K  [0201]  244.81,70.76 0 top
R36116  10K  [0201]  244.81,71.37 0 top
R36117  10K  [0201]  244.81,71.98 0 top
R36118  10K  [0201]  244.81,72.59 0 top
R36119  10K  [0201]  244.81,73.2 0 top
R36120  10K  [0201]  244.81,73.81 0 top
R36121  10K  [0201]  244.81,74.42 0 top
R36122  10K  [0201]  244.81,75.03 0 top
R36123  10K  [0201]  244.81,75.64 0 top
R36124  10K  [0201]  244.81,76.25 0 top
R36125  10K  [0201]  244.81,76.86 0 top
R36126  10K  [0201]  244.81,77.47 0 top
R36127  10K  [0201]  244.81,78.08 0 top
R36128  10K  [0201]  244.81,78.69 0 top
R36129  10K  [0201]  244.81,79.3 0 top
R36130  10K  [0201]  244.81,79.91 0 top
R36131  10K  [0201]  244.81,80.52 0 top
R36132  10K  [0201]  244.81,81.13 0 top
R36133  10K  [0201]  244.81,81.74 0 top
R36134  10K  [0201]  244.81,82.35 0 top
R36135  10K  [0201]  244.81,82.96 0 top
R36136  10K  [0201]  244.81,83.57 0 top
R36137  10K  [0201]  244.81,84.18 0 top
R36138  10K  [0201]  244.81,84.79 0 top
R36139  10K  [0201]  244.81,85.39 0 top
R36140  10K  [0201]  244.81,86 0 top
R36141  10K  [0201]  244.81,86.61 0 top
R36142  10K  [0201]  244.81,87.22 0 top
R36143  10K  [0201]  244.81,87.83 0 top
R36144  10K  [0201]  244.81,88.44 0 top
R36145  10K  [0201]  244.81,89.05 0 top
R36146  10K  [0201]  244.81,89.66 0 top
R36147  10K  [0201]  244.81,90.27 0 top
R36148  10K  [0201]  244.81,90.88 0 top
R36149  10K  [0201]  244.81,91.49 0 top
R36150  10K  [0201]  244.81,92.1 0 top
R36151  10K  [0201]  244.81,92.71 0 top
R36152  10K  [0201]  244.81,93.32 0 top
R36153  10K  [0201]  244.81,93.93 0 top
R36154  10K  [0201]  244.81,94.54 0 top
R36155  10K  [0201]  244.81,95.15 0 top
R36156  10K  [0201]  244.81,95.76 0 top
R36157  10K  [0201]  244.81,96.37 0 top
R36158  10K  [0201]  244.81,96.98 0 top
R36159  10K  [0201]  244.81,97.59 0 top
R36160  10K  [0201]  244.81,98.2 0 top
R36161  10K  [0201]  244.81,98.81 0 top
R36162  10K  [0201]  244.81,99.42 0 top
R36163  10K  [0201]  244.81,100.03 0 top
R36164  10K  [0201]  244.81,100.63 0 top
R36165  10K  [0201]  244.81,101.24 0 top
R36166  10K  [0201]  244.81,101.85 0 top
R36167  10K  [0201]  244.81,102.46 0 top
R36168  10K  [0201]  244.81,103.07 0 top
R36169  10K  [0201]  244.81,103.68 0 top
R36170  10K  [0201]  244.81,104.29 0 top
R36171  10K  [0201]  244.81,104.9 0 top
R36172  10K  [0201]  244.81,105.51 0 top
R36173  10K  [0201]  244.81,106.12 0 top
R36174  10K  [0201]  244.81,106.73 0 top
R36175  10K  [0201]  244.81,107.34 0 top
R36176  10K  [0201]  244.81,107.95 0 top
R36177  10K  [0201]  244.81,108.56 0 top
R36178  10K  [0201]  244.81,109.17 0 top
R36179  10K  [0201]  244.81,109.78 0 top
R36180  10K  [0201]  244.81,110.39 0 top
R36181  10K  [0201]  244.81,111 0 top
R36182  10K  [0201]  244.81,111.61 0 top
R36183  10K  [0201]  244.81,112.22 0 top
R36184  10K  [0201]  244.81,112.83 0 top
R36185  10K  [0201]  244.81,113.44 0 top
R36186  10K  [0201]  244.81,114.05 0 top
R36187  10K  [0201]  244.81,114.66 0 top
R36188  10K  [0201]  244.81,115.27 0 top
R36189  10K  [0201]  244.81,115.87 0 top
R36190  10K  [0201]  244.81,116.48 0 top
R36191  10K  [0201]  244.81,117.09 0 top
R36192  10K  [0201]  244.81,117.7 0 top
R36193  10K  [0201]  244.81,118.31 0 top
R36194  10K  [0201]  244.81,118.92 0 top
R36195  10K  [0201]  244.81,119.53 0 top
R36196  10K  [0201]  244.81,120.14 0 top
R36197  10K  [0201]  244.81,120.75 0 top
R36198  10K  [0201]  244.81,121.36 0 top
R36199  10K  [0201]  244.81,121.97 0 top
R36200  10K  [0201]  244.81,122.58 0 top
R36201  10K  [0201]  246.02,1.27 0 top
R36202  10K  [0201]  246.02,1.88 0 top
R36203  10K  [0201]  246.02,2.49 0 top
R36204  10K  [0201]  246.02,3.1 0 top
R36205  10K  [0201]  246.02,3.71 0 top
R36206  10K  [0201]  246.02,4.32 0 top
R36207  10K  [0201]  246.02,4.93 0 top
R36208  10K  [0201]  246.02,5.54 0 top
R36209  10K  [0201]  246.02,6.15 0 top
R36210  10K  [0201]  246.02,6.76 0 top
R36211  10K  [0201]  246.02,7.37 0 top
R36212  10K  [0201]  246.02,7.98 0 top
R36213  10K  [0201]  246.02,8.59 0 top
R36214  10K  [0201]  246.02,9.19 0 top
R36215  10K  [0201]  246.02,9.8 0 top
R36216  10K  [0201]  246.02,10.41 0 top
R36217  10K  [0201]  246.02,11.02 0 top
R36218  10K  [0201]  246.02,11.63 0 top
R36219  10K  [0201]  246.02,12.24 0 top
R36220  10K  [0201]  246.02,12.85 0 top
R36221  10K  [0201]  246.02,13.46 0 top
R36222  10K  [0201]  246.02,14.07 0 top
R36223  10K  [0201]  246.02,14.68 0 top
R36224  10K  [0201]  246.02,15.29 0 top
R36225  10K  [0201]  246.02,15.9 0 top
R36226  10K  [0201]  246.02,16.51 0 top
R36227  10K  [0201]  246.02,17.12 0 top
R36228  10K  [0201]  246.02,17.73 0 top
R36229  10K  [0201]  246.02,18.34 0 top
R36230  10K  [0201]  246.02,18.95 0 top
R36231  10K  [0201]  246.02,19.56 0 top
R36232  10K  [0201]  246.02,20.17 0 top
R36233  10K  [0201]  246.02,20.78 0 top
R36234  10K  [0201]  246.02,21.39 0 top
R36235  10K  [0201]  246.02,22 0 top
R36236  10K  [0201]  246.02,22.61 0 top
R36237  10K  [0201]  246.02,23.22 0 top
R36238  10K  [0201]  246.02,23.83 0 top
R36239  10K  [0201]  246.02,24.43 0 top
R36240  10K  [0201]  246.02,25.04 0 top
R36241  10K  [0201]  246.02,25.65 0 top
R36242  10K  [0201]  246.02,26.26 0 top
R36243  10K  [0201]  246.02,26.87 0 top
R36244  10K  [0201]  246.02,27.48 0 top
R36245  10K  [0201]  246.02,28.09 0 top
R36246  10K  [0201]  246.02,28.7 0 top
R36247  10K  [0201]  246.02,29.31 0 top
R36248  10K  [0201]  246.02,29.92 0 top
R36249  10K  [0201]  246.02,30.53 0 top
R36250  10K  [0201]  246.02,31.14 0 top
R36251  10K  [0201]  246.02,31.75 0 top
R36252  10K  [0201]  246.02,32.36 0 top
R36253  10K  [0201]  246.02,32.97 0 top
R36254  10K  [0201]  246.02,33.58 0 top
R36255  10K  [0201]  246.02,34.19 0 top
R36256  10K  [0201]  246.02,34.8 0 top
R36257  10K  [0201]  246.02,35.41 0 top
R36258  10K  [0201]  246.02,36.02 0 top
R36259  10K  [0201]  246.02,36.63 0 top
R36260  10K  [0201]  246.02,37.24 0 top
R36261  10K  [0201]  246.02,37.85 0 top
R36262  10K  [0201]  246.02,38.46 0 top
R36263  10K  [0201]  246.02,39.07 0 top
R36264  10K  [0201]  246.02,39.67 0 top
R36265  10K  [0201]  246.02,40.28 0 top
R36266  10K  [0201]  246.02,40.89 0 top
R36267  10K  [0201]  246.02,41.5 0 top
R36268  10K  [0201]  246.02,42.11 0 top
R36269  10K  [0201]  246.02,42.72 0 top
R36270  10K  [0201]  246.02,43.33 0 top
R36271  10K  [0201]  246.02,43.94 0 top
R36272  10K  [0201]  246.02,44.55 0 top
R36273  10K  [0201]  246.02,45.16 0 top
R36274  10K  [0201]  246.02,45.77 0 top
R36275  10K  [0201]  246.02,46.38 0 top
R36276  10K  [0201]  246.02,46.99 0 top
R36277  10K  [0201]  246.02,47.6 0 top
R36278  10K  [0201]  246.02,48.21 0 top
R36279  10K  [0201]  246.02,48.82 0 top
R36280  10K  [0201]  246.02,49.43 0 top
R36281  10K  [0201]  246.02,50.04 0 top
R36282  10K  [0201]  246.02,50.65 0 top
R36283  10K  [0201]  246.02,51.26 0 top
R36284  10K  [0201]  246.02,51.87 0 top
R36285  10K  [0201]  246.02,52.48 0 top
R36286  10K  [0201]  246.02,53.09 0 top
R36287  10K  [0201]  246.02,53.7 0 top
R36288  10K  [0201]  246.02,54.31 0 top
R36289  10K  [0201]  246.02,54.91 0 top
R36290  10K  [0201]  246.02,55.52 0 top
R36291  10K  [0201]  246.02,56.13 0 top
R36292  10K  [0201]  246.02,56.74 0 top
R36293  10K  [0201]  246.02,57.35 0 top
R36294  10K  [0201]  246.02,57.96 0 top
R36295  10K  [0201]  246.02,58.57 0 top
R36296  10K  [0201]  246.02,59.18 0 top
R36297  10K  [0201]  246.02,59.79 0 top
R36298  10K  [0201]  246.02,60.4 0 top
R36299  10K  [0201]  246.02,61.01 0 top
R36300  10K  [0201]  246.02,61.62 0 top
R36301  10K  [0201]  246.02,62.23 0 top
R36302  10K  [0201]  246.02,62.84 0 top
R36303  10K  [0201]  246.02,63.45 0 top
R36304  10K  [0201]  246.02,64.06 0 top
R36305  10K  [0201]  246.02,64.67 0 top
R36306  10K  [0201]  246.02,65.28 0 top
R36307  10K  [0201]  246.02,65.89 0 top
R36308  10K  [0201]  246.02,66.5 0 top
R36309  10K  [0201]  246.02,67.11 0 top
R36310  10K  [0201]  246.02,67.72 0 top
R36311  10K  [0201]  246.02,68.33 0 top
R36312  10K  [0201]  246.02,68.94 0 top
R36313  10K  [0201]  246.02,69.55 0 top
R36314  10K  [0201]  246.02,70.15 0 top
R36315  10K  [0201]  246.02,70.76 0 top
R36316  10K  [0201]  246.02,71.37 0 top
R36317  10K  [0201]  246.02,71.98 0 top
R36318  10K  [0201]  246.02,72.59 0 top
R36319  10K  [0201]  246.02,73.2 0 top
R36320  10K  [0201]  246.02,73.81 0 top
R36321  10K  [0201]  246.02,74.42 0 top
R36322  10K  [0201]  246.02,75.03 0 top
R36323  10K  [0201]  246.02,75.64 0 top
R36324  10K  [0201]  246.02,76.25 0 top
R36325  10K  [0201]  246.02,76.86 0 top
R36326  10K  [0201]  246.02,77.47 0 top
R36327  10K  [0201]  246.02,78.08 0 top
R36328  10K  [0201]  246.02,78.69 0 top
R36329  10K  [0201]  246.02,79.3 0 top
R36330  10K  [0201]  246.02,79.91 0 top
R36331  10K  [0201]  246.02,80.52 0 top
R36332  10K  [0201]  246.02,81.13 0 top
R36333  10K  [0201]  246.02,81.74 0 top
R36334  10K  [0201]  246.02,82.35 0 top
R36335  10K  [0201]  246.02,82.96 0 top
R36336  10K  [0201]  246.02,83.57 0 top
R36337  10K  [0201]  246.02,84.18 0 top
R36338  10K  [0201]  246.02,84.79 0 top
R36339  10K  [0201]  246.02,85.39 0 top
R36340  10K  [0201]  246.02,86 0 top
R36341  10K  [0201]  246.02,86.61 0 top
R36342  10K  [0201]  246.02,87.22 0 top
R36343  10K  [0201]  246.02,87.83 0 top
R36344  10K  [0201]  246.02,88.44 0 top
R36345  10K  [0201]  246.02,89.05 0 top
R36346  10K  [0201]  246.02,89.66 0 top
R36347  10K  [0201]  246.02,90.27 0 top
R36348  10K  [0201]  246.02,90.88 0 top
R36349  10K  [0201]  246.02,91.49 0 top
R36350  10K  [0201]  246.02,92.1 0 top
R36351  10K  [0201]  246.02,92.71 0 top
R36352  10K  [0201]  246.02,93.32 0 top
R36353  10K  [0201]  246.02,93.93 0 top
R36354  10K  [0201]  246.02,94.54 0 top
R36355  10K  [0201]  246.02,95.15 0 top
R36356  10K  [0201]  246.02,95.76 0 top
R36357  10K  [0201]  246.02,96.37 0 top
R36358  10K  [0201]  246.02,96.98 0 top
R36359  10K  [0201]  246.02,97.59 0 top
R36360  10K  [0201]  246.02,98.2 0 top
R36361  10K  [0201]  246.02,98.81 0 top
R36362  10K  [0201]  246.02,99.42 0 top
R36363  10K  [0201]  246.02,100.03 0 top
R36364  10K  [0201]  246.02,100.63 0 top
R36365  10K  [0201]  246.02,101.24 0 top
R36366  10K  [0201]  246.02,101.85 0 top
R36367  10K  [0201]  246.02,102.46 0 top
R36368  10K  [0201]  246.02,103.07 0 top
R36369  10K  [0201]  246.02,103.68 0 top
R36370  10K  [0201]  246.02,104.29 0 top
R36371  10K  [0201]  246.02,104.9 0 top
R36372  10K  [0201]  246.02,105.51 0 top
R36373  10K  [0201]  246.02,106.12 0 top
R36374  10K  [0201]  246.02,106.73 0 top
R36375  10K  [0201]  246.02,107.34 0 top
R36376  10K  [0201]  246.02,107.95 0 top
R36377  10K  [0201]  246.02,108.56 0 top
R36378  10K  [0201]  246.02,109.17 0 top
R36379  10K  [0201]  246.02,109.78 0 top
R36380  10K  [0201]  246.02,110.39 0 top
R36381  10K  [0201]  246.02,111 0 top
R36382  10K  [0201]  246.02,111.61 0 top
R36383  10K  [0201]  246.02,112.22 0 top
R36384  10K  [0201]  246.02,112.83 0 top
R36385  10K  [0201]  246.02,113.44 0 top
R36386  10K  [0201]  246.02,114.05 0 top
R36387  10K  [0201]  246.02,114.66 0 top
R36388  10K  [0201]  246.02,115.27 0 top
R36389  10K  [0201]  246.02,115.87 0 top
R36390  10K  [0201]  246.02,116.48 0 top
R36391  10K  [0201]  246.02,117.09 0 top
R36392  10K  [0201]  246.02,117.7 0 top
R36393  10K  [0201]  246.02,118.31 0 top
R36394  10K  [0201]  246.02,118.92 0 top
R36395  10K  [0201]  246.02,119.53 0 top
R36396  10K  [0201]  246.02,120.14 0 top
R36397  10K  [0201]  246.02,120.75 0 top
R36398  10K  [0201]  246.02,121.36 0 top
R36399  10K  [0201]  246.02,121.97 0 top
R36400  10K  [0201]  246.02,122.58 0 top
R36401  10K  [0201]  247.24,1.27 0 top
R36402  10K  [0201]  247.24,1.88 0 top
R36403  10K  [0201]  247.24,2.49 0 top
R36404  10K  [0201]  247.24,3.1 0 top
R36405  10K  [0201]  247.24,3.71 0 top
R36406  10K  [0201]  247.24,4.32 0 top
R36407  10K  [0201]  247.24,4.93 0 top
R36408  10K  [0201]  247.24,5.54 0 top
R36409  10K  [0201]  247.24,6.15 0 top
R36410  10K  [0201]  247.24,6.76 0 top
R36411  10K  [0201]  247.24,7.37 0 top
R36412  10K  [0201]  247.24,7.98 0 top
R36413  10K  [0201]  247.24,8.59 0 top
R36414  10K  [0201]  247.24,9.19 0 top
R36415  10K  [0201]  247.24,9.8 0 top
R36416  10K  [0201]  247.24,10.41 0 top
R36417  10K  [0201]  247.24,11.02 0 top
R36418  10K  [0201]  247.24,11.63 0 top
R36419  10K  [0201]  247.24,12.24 0 top
R36420  10K  [0201]  247.24,12.85 0 top
R36421  10K  [0201]  247.24,13.46 0 top
R36422  10K  [0201]  247.24,14.07 0 top
R36423  10K  [0201]  247.24,14.68 0 top
R36424  10K  [0201]  247.24,15.29 0 top
R36425  10K  [0201]  247.24,15.9 0 top
R36426  10K  [0201]  247.24,16.51 0 top
R36427  10K  [0201]  247.24,17.12 0 top
R36428  10K  [0201]  247.24,17.73 0 top
R36429  10K  [0201]  247.24,18.34 0 top
R36430  10K  [0201]  247.24,18.95 0 top
R36431  10K  [0201]  247.24,19.56 0 top
R36432  10K  [0201]  247.24,20.17 0 top
R36433  10K  [0201]  247.24,20.78 0 top
R36434  10K  [0201]  247.24,21.39 0 top
R36435  10K  [0201]  247.24,22 0 top
R36436  10K  [0201]  247.24,22.61 0 top
R36437  10K  [0201]  247.24,23.22 0 top
R36438  10K  [0201]  247.24,23.83 0 top
R36439  10K  [0201]  247.24,24.43 0 top
R36440  10K  [0201]  247.24,25.04 0 top
R36441  10K  [0201]  247.24,25.65 0 top
R36442  10K  [0201]  247.24,26.26 0 top
R36443  10K  [0201]  247.24,26.87 0 top
R36444  10K  [0201]  247.24,27.48 0 top
R36445  10K  [0201]  247.24,28.09 0 top
R36446  10K  [0201]  247.24,28.7 0 top
R36447  10K  [0201]  247.24,29.31 0 top
R36448  10K  [0201]  247.24,29.92 0 top
R36449  10K  [0201]  247.24,30.53 0 top
R36450  10K  [0201]  247.24,31.14 0 top
R36451  10K  [0201]  247.24,31.75 0 top
R36452  10K  [0201]  247.24,32.36 0 top
R36453  10K  [0201]  247.24,32.97 0 top
R36454  10K  [0201]  247.24,33.58 0 top
R36455  10K  [0201]  247.24,34.19 0 top
R36456  10K  [0201]  247.24,34.8 0 top
R36457  10K  [0201]  247.24,35.41 0 top
R36458  10K  [0201]  247.24,36.02 0 top
R36459  10K  [0201]  247.24,36.63 0 top
R36460  10K  [0201]  247.24,37.24 0 top
R36461  10K  [0201]  247.24,37.85 0 top
R36462  10K  [0201]  247.24,38.46 0 top
R36463  10K  [0201]  247.24,39.07 0 top
R36464  10K  [0201]  247.24,39.67 0 top
R36465  10K  [0201]  247.24,40.28 0 top
R36466  10K  [0201]  247.24,40.89 0 top
R36467  10K  [0201]  247.24,41.5 0 top
R36468  10K  [0201]  247.24,42.11 0 top
R36469  10K  [0201]  247.24,42.72 0 top
R36470  10K  [0201]  247.24,43.33 0 top
R36471  10K  [0201]  247.24,43.94 0 top
R36472  10K  [0201]  247.24,44.55 0 top
R36473  10K  [0201]  247.24,45.16 0 top
R36474  10K  [0201]  247.24,45.77 0 top
R36475  10K  [0201]  247.24,46.38 0 top
R36476  10K  [0201]  247.24,46.99 0 top
R36477  10K  [0201]  247.24,47.6 0 top
R36478  10K  [0201]  247.24,48.21 0 top
R36479  10K  [0201]  247.24,48.82 0 top
R36480  10K  [0201]  247.24,49.43 0 top
R36481  10K  [0201]  247.24,50.04 0 top
R36482  10K  [0201]  247.24,50.65 0 top
R36483  10K  [0201]  247.24,51.26 0 top
R36484  10K  [0201]  247.24,51.87 0 top
R36485  10K  [0201]  247.24,52.48 0 top
R36486  10K  [0201]  247.24,53.09 0 top
R36487  10K  [0201]  247.24,53.7 0 top
R36488  10K  [0201]  247.24,54.31 0 top
R36489  10K  [0201]  247.24,54.91 0 top
R36490  10K  [0201]  247.24,55.52 0 top
R36491  10K  [0201]  247.24,56.13 0 top
R36492  10K  [0201]  247.24,56.74 0 top
R36493  10K  [0201]  247.24,57.35 0 top
R36494  10K  [0201]  247.24,57.96 0 top
R36495  10K  [0201]  247.24,58.57 0 top
R36496  10K  [0201]  247.24,59.18 0 top
R36497  10K  [0201]  247.24,59.79 0 top
R36498  10K  [0201]  247.24,60.4 0 top
R36499  10K  [0201]  247.24,61.01 0 top
R36500  10K  [0201]  247.24,61.62 0 top
R36501  10K  [0201]  247.24,62.23 0 top
R36502  10K  [0201]  247.24,62.84 0 top
R36503  10K  [0201]  247.24,63.45 0 top
R36504  10K  [0201]  247.24,64.06 0 top
R36505  10K  [0201]  247.24,64.67 0 top
R36506  10K  [0201]  247.24,65.28 0 top
R36507  10K  [0201]  247.24,65.89 0 top
R36508  10K  [0201]  247.24,66.5 0 top
R36509  10K  [0201]  247.24,67.11 0 top
R36510  10K  [0201]  247.24,67.72 0 top
R36511  10K  [0201]  247.24,68.33 0 top
R36512  10K  [0201]  247.24,68.94 0 top
R36513  10K  [0201]  247.24,69.55 0 top
R36514  10K  [0201]  247.24,70.15 0 top
R36515  10K  [0201]  247.24,70.76 0 top
R36516  10K  [0201]  247.24,71.37 0 top
R36517  10K  [0201]  247.24,71.98 0 top
R36518  10K  [0201]  247.24,72.59 0 top
R36519  10K  [0201]  247.24,73.2 0 top
R36520  10K  [0201]  247.24,73.81 0 top
R36521  10K  [0201]  247.24,74.42 0 top
R36522  10K  [0201]  247.24,75.03 0 top
R36523  10K  [0201]  247.24,75.64 0 top
R36524  10K  [0201]  247.24,76.25 0 top
R36525  10K  [0201]  247.24,76.86 0 top
R36526  10K  [0201]  247.24,77.47 0 top
R36527  10K  [0201]  247.24,78.08 0 top
R36528  10K  [0201]  247.24,78.69 0 top
R36529  10K  [0201]  247.24,79.3 0 top
R36530  10K  [0201]  247.24,79.91 0 top
R36531  10K  [0201]  247.24,80.52 0 top
R36532  10K  [0201]  247.24,81.13 0 top
R36533  10K  [0201]  247.24,81.74 0 top
R36534  10K  [0201]  247.24,82.35 0 top
R36535  10K  [0201]  247.24,82.96 0 top
R36536  10K  [0201]  247.24,83.57 0 top
R36537  10K  [0201]  247.24,84.18 0 top
R36538  10K  [0201]  247.24,84.79 0 top
R36539  10K  [0201]  247.24,85.39 0 top
R36540  10K  [0201]  247.24,86 0 top
R36541  10K  [0201]  247.24,86.61 0 top
R36542  10K  [0201]  247.24,87.22 0 top
R36543  10K  [0201]  247.24,87.83 0 top
R36544  10K  [0201]  247.24,88.44 0 top
R36545  10K  [0201]  247.24,89.05 0 top
R36546  10K  [0201]  247.24,89.66 0 top
R36547  10K  [0201]  247.24,90.27 0 top
R36548  10K  [0201]  247.24,90.88 0 top
R36549  10K  [0201]  247.24,91.49 0 top
R36550  10K  [0201]  247.24,92.1 0 top
R36551  10K  [0201]  247.24,92.71 0 top
R36552  10K  [0201]  247.24,93.32 0 top
R36553  10K  [0201]  247.24,93.93 0 top
R36554  10K  [0201]  247.24,94.54 0 top
R36555  10K  [0201]  247.24,95.15 0 top
R36556  10K  [0201]  247.24,95.76 0 top
R36557  10K  [0201]  247.24,96.37 0 top
R36558  10K  [0201]  247.24,96.98 0 top
R36559  10K  [0201]  247.24,97.59 0 top
R36560  10K  [0201]  247.24,98.2 0 top
R36561  10K  [0201]  247.24,98.81 0 top
R36562  10K  [0201]  247.24,99.42 0 top
R36563  10K  [0201]  247.24,100.03 0 top
R36564  10K  [0201]  247.24,100.63 0 top
R36565  10K  [0201]  247.24,101.24 0 top
R36566  10K  [0201]  247.24,101.85 0 top
R36567  10K  [0201]  247.24,102.46 0 top
R36568  10K  [0201]  247.24,103.07 0 top
R36569  10K  [0201]  247.24,103.68 0 top
R36570  10K  [0201]  247.24,104.29 0 top
R36571  10K  [0201]  247.24,104.9 0 top
R36572  10K  [0201]  247.24,105.51 0 top
R36573  10K  [0201]  247.24,106.12 0 top
R36574  10K  [0201]  247.24,106.73 0 top
R36575  10K  [0201]  247.24,107.34 0 top
R36576  10K  [0201]  247.24,107.95 0 top
R36577  10K  [0201]  247.24,108.56 0 top
R36578  10K  [0201]  247.24,109.17 0 top
R36579  10K  [0201]  247.24,109.78 0 top
R36580  10K  [0201]  247.24,110.39 0 top
R36581  10K  [0201]  247.24,111 0 top
R36582  10K  [0201]  247.24,111.61 0 top
R36583  10K  [0201]  247.24,112.22 0 top
R36584  10K  [0201]  247.24,112.83 0 top
R36585  10K  [0201]  247.24,113.44 0 top
R36586  10K  [0201]  247.24,114.05 0 top
R36587  10K  [0201]  247.24,114.66 0 top
R36588  10K  [0201]  247.24,115.27 0 top
R36589  10K  [0201]  247.24,115.87 0 top
R36590  10K  [0201]  247.24,116.48 0 top
R36591  10K  [0201]  247.24,117.09 0 top
R36592  10K  [0201]  247.24,117.7 0 top
R36593  10K  [0201]  247.24,118.31 0 top
R36594  10K  [0201]  247.24,118.92 0 top
R36595  10K  [0201]  247.24,119.53 0 top
R36596  10K  [0201]  247.24,120.14 0 top
R36597  10K  [0201]  247.24,120.75 0 top
R36598  10K  [0201]  247.24,121.36 0 top
R36599  10K  [0201]  247.24,121.97 0 top
R36600  10K  [0201]  247.24,122.58 0 top
R36601  10K  [0201]  248.46,1.27 0 top
R36602  10K  [0201]  248.46,1.88 0 top
R36603  10K  [0201]  248.46,2.49 0 top
R36604  10K  [0201]  248.46,3.1 0 top
R36605  10K  [0201]  248.46,3.71 0 top
R36606  10K  [0201]  248.46,4.32 0 top
R36607  10K  [0201]  248.46,4.93 0 top
R36608  10K  [0201]  248.46,5.54 0 top
R36609  10K  [0201]  248.46,6.15 0 top
R36610  10K  [0201]  248.46,6.76 0 top
R36611  10K  [0201]  248.46,7.37 0 top
R36612  10K  [0201]  248.46,7.98 0 top
R36613  10K  [0201]  248.46,8.59 0 top
R36614  10K  [0201]  248.46,9.19 0 top
R36615  10K  [0201]  248.46,9.8 0 top
R36616  10K  [0201]  248.46,10.41 0 top
R36617  10K  [0201]  248.46,11.02 0 top
R36618  10K  [0201]  248.46,11.63 0 top
R36619  10K  [0201]  248.46,12.24 0 top
R36620  10K  [0201]  248.46,12.85 0 top
R36621  10K  [0201]  248.46,13.46 0 top
R36622  10K  [0201]  248.46,14.07 0 top
R36623  10K  [0201]  248.46,14.68 0 top
R36624  10K  [0201]  248.46,15.29 0 top
R36625  10K  [0201]  248.46,15.9 0 top
R36626  10K  [0201]  248.46,16.51 0 top
R36627  10K  [0201]  248.46,17.12 0 top
R36628  10K  [0201]  248.46,17.73 0 top
R36629  10K  [0201]  248.46,18.34 0 top
R36630  10K  [0201]  248.46,18.95 0 top
R36631  10K  [0201]  248.46,19.56 0 top
R36632  10K  [0201]  248.46,20.17 0 top
R36633  10K  [0201]  248.46,20.78 0 top
R36634  10K  [0201]  248.46,21.39 0 top
R36635  10K  [0201]  248.46,22 0 top
R36636  10K  [0201]  248.46,22.61 0 top
R36637  10K  [0201]  248.46,23.22 0 top
R36638  10K  [0201]  248.46,23.83 0 top
R36639  10K  [0201]  248.46,24.43 0 top
R36640  10K  [0201]  248.46,25.04 0 top
R36641  10K  [0201]  248.46,25.65 0 top
R36642  10K  [0201]  248.46,26.26 0 top
R36643  10K  [0201]  248.46,26.87 0 top
R36644  10K  [0201]  248.46,27.48 0 top
R36645  10K  [0201]  248.46,28.09 0 top
R36646  10K  [0201]  248.46,28.7 0 top
R36647  10K  [0201]  248.46,29.31 0 top
R36648  10K  [0201]  248.46,29.92 0 top
R36649  10K  [0201]  248.46,30.53 0 top
R36650  10K  [0201]  248.46,31.14 0 top
R36651  10K  [0201]  248.46,31.75 0 top
R36652  10K  [0201]  248.46,32.36 0 top
R36653  10K  [0201]  248.46,32.97 0 top
R36654  10K  [0201]  248.46,33.58 0 top
R36655  10K  [0201]  248.46,34.19 0 top
R36656  10K  [0201]  248.46,34.8 0 top
R36657  10K  [0201]  248.46,35.41 0 top
R36658  10K  [0201]  248.46,36.02 0 top
R36659  10K  [0201]  248.46,36.63 0 top
R36660  10K  [0201]  248.46,37.24 0 top
R36661  10K  [0201]  248.46,37.85 0 top
R36662  10K  [0201]  248.46,38.46 0 top
R36663  10K  [0201]  248.46,39.07 0 top
R36664  10K  [0201]  248.46,39.67 0 top
R36665  10K  [0201]  248.46,40.28 0 top
R36666  10K  [0201]  248.46,40.89 0 top
R36667  10K  [0201]  248.46,41.5 0 top
R36668  10K  [0201]  248.46,42.11 0 top
R36669  10K  [0201]  248.46,42.72 0 top
R36670  10K  [0201]  248.46,43.33 0 top
R36671  10K  [0201]  248.46,43.94 0 top
R36672  10K  [0201]  248.46,44.55 0 top
R36673  10K  [0201]  248.46,45.16 0 top
R36674  10K  [0201]  248.46,45.77 0 top
R36675  10K  [0201]  248.46,46.38 0 top